# EAGLE schematic Resistor_Resistor (EAGLE 8.3.0), part 41 of 43
## Nets (continued)
N$173: R32601.2 R32602.2 R32603.2 R32604.2 R32605.2 R32606.2 R32607.2 R32608.2 R32609.2 R32610.2 R32611.2 R32612.2 R32613.2 R32614.2 R32615.2 R32616.2 R32617.2 R32618.2 R32619.2 R32620.2 R32621.2 R32622.2 R32623.2 R32624.2 R32625.2 R32626.2 R32627.2 R32628.2 R32629.2 R32630.2 R32631.2 R32632.2 R32633.2 R32634.2 R32635.2 R32636.2 R32637.2 R32638.2 R32639.2 R32640.2 R32641.2 R32642.2 R32643.2 R32644.2 R32645.2 R32646.2 R32647.2 R32648.2 R32649.2 R32650.2 R32651.2 R32652.2 R32653.2 R32654.2 R32655.2 R32656.2 R32657.2 R32658.2 R32659.2 R32660.2 R32661.2 R32662.2 R32663.2 R32664.2 R32665.2 R32666.2 R32667.2 R32668.2 R32669.2 R32670.2 R32671.2 R32672.2 R32673.2 R32674.2 R32675.2 R32676.2 R32677.2 R32678.2 R32679.2 R32680.2 R32681.2 R32682.2 R32683.2 R32684.2 R32685.2 R32686.2 R32687.2 R32688.2 R32689.2 R32690.2 R32691.2 R32692.2 R32693.2 R32694.2 R32695.2 R32696.2 R32697.2 R32698.2 R32699.2 R32700.2 R32701.2 R32702.2 R32703.2 R32704.2 R32705.2 R32706.2 R32707.2 R32708.2 R32709.2 R32710.2 R32711.2 R32712.2 R32713.2 R32714.2 R32715.2 R32716.2 R32717.2 R32718.2 R32719.2 R32720.2 R32721.2 R32722.2 R32723.2 R32724.2 R32725.2 R32726.2 R32727.2 R32728.2 R32729.2 R32730.2 R32731.2 R32732.2 R32733.2 R32734.2 R32735.2 R32736.2 R32737.2 R32738.2 R32739.2 R32740.2 R32741.2 R32742.2 R32743.2 R32744.2 R32745.2 R32746.2 R32747.2 R32748.2 R32749.2 R32750.2 R32751.2 R32752.2 R32753.2 R32754.2 R32755.2 R32756.2 R32757.2 R32758.2 R32759.2 R32760.2 R32761.2 R32762.2 R32763.2 R32764.2 R32765.2 R32766.2 R32767.2 R32768.2 R32769.2 R32770.2 R32771.2 R32772.2 R32773.2 R32774.2 R32775.2 R32776.2 R32777.2 R32778.2 R32779.2 R32780.2 R32781.2 R32782.2 R32783.2 R32784.2 R32785.2 R32786.2 R32787.2 R32788.2 R32789.2 R32790.2 R32791.2 R32792.2 R32793.2 R32794.2 R32795.2 R32796.2 R32797.2 R32798.2 R32799.2 R32800.2 R32801.1 R32802.1 R32803.1 R32804.1 R32805.1 R32806.1 R32807.1 R32808.1 R32809.1 R32810.1 R32811.1 R32812.1 R32813.1 R32814.1 R32815.1 R32816.1 R32817.1 R32818.1 R32819.1 R32820.1 R32821.1 R32822.1 R32823.1 R32824.1 R32825.1 R32826.1 R32827.1 R32828.1 R32829.1 R32830.1 R32831.1 R32832.1 R32833.1 R32834.1 R32835.1 R32836.1 R32837.1 R32838.1 R32839.1 R32840.1 R32841.1 R32842.1 R32843.1 R32844.1 R32845.1 R32846.1 R32847.1 R32848.1 R32849.1 R32850.1 R32851.1 R32852.1 R32853.1 R32854.1 R32855.1 R32856.1 R32857.1 R32858.1 R32859.1 R32860.1 R32861.1 R32862.1 R32863.1 R32864.1 R32865.1 R32866.1 R32867.1 R32868.1 R32869.1 R32870.1 R32871.1 R32872.1 R32873.1 R32874.1 R32875.1 R32876.1 R32877.1 R32878.1 R32879.1 R32880.1 R32881.1 R32882.1 R32883.1 R32884.1 R32885.1 R32886.1 R32887.1 R32888.1 R32889.1 R32890.1 R32891.1 R32892.1 R32893.1 R32894.1 R32895.1 R32896.1 R32897.1 R32898.1 R32899.1 R32900.1 R32901.1 R32902.1 R32903.1 R32904.1 R32905.1 R32906.1 R32907.1 R32908.1 R32909.1 R32910.1 R32911.1 R32912.1 R32913.1 R32914.1 R32915.1 R32916.1 R32917.1 R32918.1 R32919.1 R32920.1 R32921.1 R32922.1 R32923.1 R32924.1 R32925.1 R32926.1 R32927.1 R32928.1 R32929.1 R32930.1 R32931.1 R32932.1 R32933.1 R32934.1 R32935.1 R32936.1 R32937.1 R32938.1 R32939.1 R32940.1 R32941.1 R32942.1 R32943.1 R32944.1 R32945.1 R32946.1 R32947.1 R32948.1 R32949.1 R32950.1 R32951.1 R32952.1 R32953.1 R32954.1 R32955.1 R32956.1 R32957.1 R32958.1 R32959.1 R32960.1 R32961.1 R32962.1 R32963.1 R32964.1 R32965.1 R32966.1 R32967.1 R32968.1 R32969.1 R32970.1 R32971.1 R32972.1 R32973.1 R32974.1 R32975.1 R32976.1 R32977.1 R32978.1 R32979.1 R32980.1 R32981.1 R32982.1 R32983.1 R32984.1 R32985.1 R32986.1 R32987.1 R32988.1 R32989.1 R32990.1 R32991.1 R32992.1 R32993.1 R32994.1 R32995.1 R32996.1 R32997.1 R32998.1 R32999.1 R33000.1
N$174: R32801.2 R32802.2 R32803.2 R32804.2 R32805.2 R32806.2 R32807.2 R32808.2 R32809.2 R32810.2 R32811.2 R32812.2 R32813.2 R32814.2 R32815.2 R32816.2 R32817.2 R32818.2 R32819.2 R32820.2 R32821.2 R32822.2 R32823.2 R32824.2 R32825.2 R32826.2 R32827.2 R32828.2 R32829.2 R32830.2 R32831.2 R32832.2 R32833.2 R32834.2 R32835.2 R32836.2 R32837.2 R32838.2 R32839.2 R32840.2 R32841.2 R32842.2 R32843.2 R32844.2 R32845.2 R32846.2 R32847.2 R32848.2 R32849.2 R32850.2 R32851.2 R32852.2 R32853.2 R32854.2 R32855.2 R32856.2 R32857.2 R32858.2 R32859.2 R32860.2 R32861.2 R32862.2 R32863.2 R32864.2 R32865.2 R32866.2 R32867.2 R32868.2 R32869.2 R32870.2 R32871.2 R32872.2 R32873.2 R32874.2 R32875.2 R32876.2 R32877.2 R32878.2 R32879.2 R32880.2 R32881.2 R32882.2 R32883.2 R32884.2 R32885.2 R32886.2 R32887.2 R32888.2 R32889.2 R32890.2 R32891.2 R32892.2 R32893.2 R32894.2 R32895.2 R32896.2 R32897.2 R32898.2 R32899.2 R32900.2 R32901.2 R32902.2 R32903.2 R32904.2 R32905.2 R32906.2 R32907.2 R32908.2 R32909.2 R32910.2 R32911.2 R32912.2 R32913.2 R32914.2 R32915.2 R32916.2 R32917.2 R32918.2 R32919.2 R32920.2 R32921.2 R32922.2 R32923.2 R32924.2 R32925.2 R32926.2 R32927.2 R32928.2 R32929.2 R32930.2 R32931.2 R32932.2 R32933.2 R32934.2 R32935.2 R32936.2 R32937.2 R32938.2 R32939.2 R32940.2 R32941.2 R32942.2 R32943.2 R32944.2 R32945.2 R32946.2 R32947.2 R32948.2 R32949.2 R32950.2 R32951.2 R32952.2 R32953.2 R32954.2 R32955.2 R32956.2 R32957.2 R32958.2 R32959.2 R32960.2 R32961.2 R32962.2 R32963.2 R32964.2 R32965.2 R32966.2 R32967.2 R32968.2 R32969.2 R32970.2 R32971.2 R32972.2 R32973.2 R32974.2 R32975.2 R32976.2 R32977.2 R32978.2 R32979.2 R32980.2 R32981.2 R32982.2 R32983.2 R32984.2 R32985.2 R32986.2 R32987.2 R32988.2 R32989.2 R32990.2 R32991.2 R32992.2 R32993.2 R32994.2 R32995.2 R32996.2 R32997.2 R32998.2 R32999.2 R33000.2 R33001.1 R33002.1 R33003.1 R33004.1 R33005.1 R33006.1 R33007.1 R33008.1 R33009.1 R33010.1 R33011.1 R33012.1 R33013.1 R33014.1 R33015.1 R33016.1 R33017.1 R33018.1 R33019.1 R33020.1 R33021.1 R33022.1 R33023.1 R33024.1 R33025.1 R33026.1 R33027.1 R33028.1 R33029.1 R33030.1 R33031.1 R33032.1 R33033.1 R33034.1 R33035.1 R33036.1 R33037.1 R33038.1 R33039.1 R33040.1 R33041.1 R33042.1 R33043.1 R33044.1 R33045.1 R33046.1 R33047.1 R33048.1 R33049.1 R33050.1 R33051.1 R33052.1 R33053.1 R33054.1 R33055.1 R33056.1 R33057.1 R33058.1 R33059.1 R33060.1 R33061.1 R33062.1 R33063.1 R33064.1 R33065.1 R33066.1 R33067.1 R33068.1 R33069.1 R33070.1 R33071.1 R33072.1 R33073.1 R33074.1 R33075.1 R33076.1 R33077.1 R33078.1 R33079.1 R33080.1 R33081.1 R33082.1 R33083.1 R33084.1 R33085.1 R33086.1 R33087.1 R33088.1 R33089.1 R33090.1 R33091.1 R33092.1 R33093.1 R33094.1 R33095.1 R33096.1 R33097.1 R33098.1 R33099.1 R33100.1 R33101.1 R33102.1 R33103.1 R33104.1 R33105.1 R33106.1 R33107.1 R33108.1 R33109.1 R33110.1 R33111.1 R33112.1 R33113.1 R33114.1 R33115.1 R33116.1 R33117.1 R33118.1 R33119.1 R33120.1 R33121.1 R33122.1 R33123.1 R33124.1 R33125.1 R33126.1 R33127.1 R33128.1 R33129.1 R33130.1 R33131.1 R33132.1 R33133.1 R33134.1 R33135.1 R33136.1 R33137.1 R33138.1 R33139.1 R33140.1 R33141.1 R33142.1 R33143.1 R33144.1 R33145.1 R33146.1 R33147.1 R33148.1 R33149.1 R33150.1 R33151.1 R33152.1 R33153.1 R33154.1 R33155.1 R33156.1 R33157.1 R33158.1 R33159.1 R33160.1 R33161.1 R33162.1 R33163.1 R33164.1 R33165.1 R33166.1 R33167.1 R33168.1 R33169.1 R33170.1 R33171.1 R33172.1 R33173.1 R33174.1 R33175.1 R33176.1 R33177.1 R33178.1 R33179.1 R33180.1 R33181.1 R33182.1 R33183.1 R33184.1 R33185.1 R33186.1 R33187.1 R33188.1 R33189.1 R33190.1 R33191.1 R33192.1 R33193.1 R33194.1 R33195.1 R33196.1 R33197.1 R33198.1 R33199.1 R33200.1
N$175: R33001.2 R33002.2 R33003.2 R33004.2 R33005.2 R33006.2 R33007.2 R33008.2 R33009.2 R33010.2 R33011.2 R33012.2 R33013.2 R33014.2 R33015.2 R33016.2 R33017.2 R33018.2 R33019.2 R33020.2 R33021.2 R33022.2 R33023.2 R33024.2 R33025.2 R33026.2 R33027.2 R33028.2 R33029.2 R33030.2 R33031.2 R33032.2 R33033.2 R33034.2 R33035.2 R33036.2 R33037.2 R33038.2 R33039.2 R33040.2 R33041.2 R33042.2 R33043.2 R33044.2 R33045.2 R33046.2 R33047.2 R33048.2 R33049.2 R33050.2 R33051.2 R33052.2 R33053.2 R33054.2 R33055.2 R33056.2 R33057.2 R33058.2 R33059.2 R33060.2 R33061.2 R33062.2 R33063.2 R33064.2 R33065.2 R33066.2 R33067.2 R33068.2 R33069.2 R33070.2 R33071.2 R33072.2 R33073.2 R33074.2 R33075.2 R33076.2 R33077.2 R33078.2 R33079.2 R33080.2 R33081.2 R33082.2 R33083.2 R33084.2 R33085.2 R33086.2 R33087.2 R33088.2 R33089.2 R33090.2 R33091.2 R33092.2 R33093.2 R33094.2 R33095.2 R33096.2 R33097.2 R33098.2 R33099.2 R33100.2 R33101.2 R33102.2 R33103.2 R33104.2 R33105.2 R33106.2 R33107.2 R33108.2 R33109.2 R33110.2 R33111.2 R33112.2 R33113.2 R33114.2 R33115.2 R33116.2 R33117.2 R33118.2 R33119.2 R33120.2 R33121.2 R33122.2 R33123.2 R33124.2 R33125.2 R33126.2 R33127.2 R33128.2 R33129.2 R33130.2 R33131.2 R33132.2 R33133.2 R33134.2 R33135.2 R33136.2 R33137.2 R33138.2 R33139.2 R33140.2 R33141.2 R33142.2 R33143.2 R33144.2 R33145.2 R33146.2 R33147.2 R33148.2 R33149.2 R33150.2 R33151.2 R33152.2 R33153.2 R33154.2 R33155.2 R33156.2 R33157.2 R33158.2 R33159.2 R33160.2 R33161.2 R33162.2 R33163.2 R33164.2 R33165.2 R33166.2 R33167.2 R33168.2 R33169.2 R33170.2 R33171.2 R33172.2 R33173.2 R33174.2 R33175.2 R33176.2 R33177.2 R33178.2 R33179.2 R33180.2 R33181.2 R33182.2 R33183.2 R33184.2 R33185.2 R33186.2 R33187.2 R33188.2 R33189.2 R33190.2 R33191.2 R33192.2 R33193.2 R33194.2 R33195.2 R33196.2 R33197.2 R33198.2 R33199.2 R33200.2 R33201.1 R33202.1 R33203.1 R33204.1 R33205.1 R33206.1 R33207.1 R33208.1 R33209.1 R33210.1 R33211.1 R33212.1 R33213.1 R33214.1 R33215.1 R33216.1 R33217.1 R33218.1 R33219.1 R33220.1 R33221.1 R33222.1 R33223.1 R33224.1 R33225.1 R33226.1 R33227.1 R33228.1 R33229.1 R33230.1 R33231.1 R33232.1 R33233.1 R33234.1 R33235.1 R33236.1 R33237.1 R33238.1 R33239.1 R33240.1 R33241.1 R33242.1 R33243.1 R33244.1 R33245.1 R33246.1 R33247.1 R33248.1 R33249.1 R33250.1 R33251.1 R33252.1 R33253.1 R33254.1 R33255.1 R33256.1 R33257.1 R33258.1 R33259.1 R33260.1 R33261.1 R33262.1 R33263.1 R33264.1 R33265.1 R33266.1 R33267.1 R33268.1 R33269.1 R33270.1 R33271.1 R33272.1 R33273.1 R33274.1 R33275.1 R33276.1 R33277.1 R33278.1 R33279.1 R33280.1 R33281.1 R33282.1 R33283.1 R33284.1 R33285.1 R33286.1 R33287.1 R33288.1 R33289.1 R33290.1 R33291.1 R33292.1 R33293.1 R33294.1 R33295.1 R33296.1 R33297.1 R33298.1 R33299.1 R33300.1 R33301.1 R33302.1 R33303.1 R33304.1 R33305.1 R33306.1 R33307.1 R33308.1 R33309.1 R33310.1 R33311.1 R33312.1 R33313.1 R33314.1 R33315.1 R33316.1 R33317.1 R33318.1 R33319.1 R33320.1 R33321.1 R33322.1 R33323.1 R33324.1 R33325.1 R33326.1 R33327.1 R33328.1 R33329.1 R33330.1 R33331.1 R33332.1 R33333.1 R33334.1 R33335.1 R33336.1 R33337.1 R33338.1 R33339.1 R33340.1 R33341.1 R33342.1 R33343.1 R33344.1 R33345.1 R33346.1 R33347.1 R33348.1 R33349.1 R33350.1 R33351.1 R33352.1 R33353.1 R33354.1 R33355.1 R33356.1 R33357.1 R33358.1 R33359.1 R33360.1 R33361.1 R33362.1 R33363.1 R33364.1 R33365.1 R33366.1 R33367.1 R33368.1 R33369.1 R33370.1 R33371.1 R33372.1 R33373.1 R33374.1 R33375.1 R33376.1 R33377.1 R33378.1 R33379.1 R33380.1 R33381.1 R33382.1 R33383.1 R33384.1 R33385.1 R33386.1 R33387.1 R33388.1 R33389.1 R33390.1 R33391.1 R33392.1 R33393.1 R33394.1 R33395.1 R33396.1 R33397.1 R33398.1 R33399.1 R33400.1
N$176: R33201.2 R33202.2 R33203.2 R33204.2 R33205.2 R33206.2 R33207.2 R33208.2 R33209.2 R33210.2 R33211.2 R33212.2 R33213.2 R33214.2 R33215.2 R33216.2 R33217.2 R33218.2 R33219.2 R33220.2 R33221.2 R33222.2 R33223.2 R33224.2 R33225.2 R33226.2 R33227.2 R33228.2 R33229.2 R33230.2 R33231.2 R33232.2 R33233.2 R33234.2 R33235.2 R33236.2 R33237.2 R33238.2 R33239.2 R33240.2 R33241.2 R33242.2 R33243.2 R33244.2 R33245.2 R33246.2 R33247.2 R33248.2 R33249.2 R33250.2 R33251.2 R33252.2 R33253.2 R33254.2 R33255.2 R33256.2 R33257.2 R33258.2 R33259.2 R33260.2 R33261.2 R33262.2 R33263.2 R33264.2 R33265.2 R33266.2 R33267.2 R33268.2 R33269.2 R33270.2 R33271.2 R33272.2 R33273.2 R33274.2 R33275.2 R33276.2 R33277.2 R33278.2 R33279.2 R33280.2 R33281.2 R33282.2 R33283.2 R33284.2 R33285.2 R33286.2 R33287.2 R33288.2 R33289.2 R33290.2 R33291.2 R33292.2 R33293.2 R33294.2 R33295.2 R33296.2 R33297.2 R33298.2 R33299.2 R33300.2 R33301.2 R33302.2 R33303.2 R33304.2 R33305.2 R33306.2 R33307.2 R33308.2 R33309.2 R33310.2 R33311.2 R33312.2 R33313.2 R33314.2 R33315.2 R33316.2 R33317.2 R33318.2 R33319.2 R33320.2 R33321.2 R33322.2 R33323.2 R33324.2 R33325.2 R33326.2 R33327.2 R33328.2 R33329.2 R33330.2 R33331.2 R33332.2 R33333.2 R33334.2 R33335.2 R33336.2 R33337.2 R33338.2 R33339.2 R33340.2 R33341.2 R33342.2 R33343.2 R33344.2 R33345.2 R33346.2 R33347.2 R33348.2 R33349.2 R33350.2 R33351.2 R33352.2 R33353.2 R33354.2 R33355.2 R33356.2 R33357.2 R33358.2 R33359.2 R33360.2 R33361.2 R33362.2 R33363.2 R33364.2 R33365.2 R33366.2 R33367.2 R33368.2 R33369.2 R33370.2 R33371.2 R33372.2 R33373.2 R33374.2 R33375.2 R33376.2 R33377.2 R33378.2 R33379.2 R33380.2 R33381.2 R33382.2 R33383.2 R33384.2 R33385.2 R33386.2 R33387.2 R33388.2 R33389.2 R33390.2 R33391.2 R33392.2 R33393.2 R33394.2 R33395.2 R33396.2 R33397.2 R33398.2 R33399.2 R33400.2 R33401.1 R33402.1 R33403.1 R33404.1 R33405.1 R33406.1 R33407.1 R33408.1 R33409.1 R33410.1 R33411.1 R33412.1 R33413.1 R33414.1 R33415.1 R33416.1 R33417.1 R33418.1 R33419.1 R33420.1 R33421.1 R33422.1 R33423.1 R33424.1 R33425.1 R33426.1 R33427.1 R33428.1 R33429.1 R33430.1 R33431.1 R33432.1 R33433.1 R33434.1 R33435.1 R33436.1 R33437.1 R33438.1 R33439.1 R33440.1 R33441.1 R33442.1 R33443.1 R33444.1 R33445.1 R33446.1 R33447.1 R33448.1 R33449.1 R33450.1 R33451.1 R33452.1 R33453.1 R33454.1 R33455.1 R33456.1 R33457.1 R33458.1 R33459.1 R33460.1 R33461.1 R33462.1 R33463.1 R33464.1 R33465.1 R33466.1 R33467.1 R33468.1 R33469.1 R33470.1 R33471.1 R33472.1 R33473.1 R33474.1 R33475.1 R33476.1 R33477.1 R33478.1 R33479.1 R33480.1 R33481.1 R33482.1 R33483.1 R33484.1 R33485.1 R33486.1 R33487.1 R33488.1 R33489.1 R33490.1 R33491.1 R33492.1 R33493.1 R33494.1 R33495.1 R33496.1 R33497.1 R33498.1 R33499.1 R33500.1 R33501.1 R33502.1 R33503.1 R33504.1 R33505.1 R33506.1 R33507.1 R33508.1 R33509.1 R33510.1 R33511.1 R33512.1 R33513.1 R33514.1 R33515.1 R33516.1 R33517.1 R33518.1 R33519.1 R33520.1 R33521.1 R33522.1 R33523.1 R33524.1 R33525.1 R33526.1 R33527.1 R33528.1 R33529.1 R33530.1 R33531.1 R33532.1 R33533.1 R33534.1 R33535.1 R33536.1 R33537.1 R33538.1 R33539.1 R33540.1 R33541.1 R33542.1 R33543.1 R33544.1 R33545.1 R33546.1 R33547.1 R33548.1 R33549.1 R33550.1 R33551.1 R33552.1 R33553.1 R33554.1 R33555.1 R33556.1 R33557.1 R33558.1 R33559.1 R33560.1 R33561.1 R33562.1 R33563.1 R33564.1 R33565.1 R33566.1 R33567.1 R33568.1 R33569.1 R33570.1 R33571.1 R33572.1 R33573.1 R33574.1 R33575.1 R33576.1 R33577.1 R33578.1 R33579.1 R33580.1 R33581.1 R33582.1 R33583.1 R33584.1 R33585.1 R33586.1 R33587.1 R33588.1 R33589.1 R33590.1 R33591.1 R33592.1 R33593.1 R33594.1 R33595.1 R33596.1 R33597.1 R33598.1 R33599.1 R33600.1
N$177: R33401.2 R33402.2 R33403.2 R33404.2 R33405.2 R33406.2 R33407.2 R33408.2 R33409.2 R33410.2 R33411.2 R33412.2 R33413.2 R33414.2 R33415.2 R33416.2 R33417.2 R33418.2 R33419.2 R33420.2 R33421.2 R33422.2 R33423.2 R33424.2 R33425.2 R33426.2 R33427.2 R33428.2 R33429.2 R33430.2 R33431.2 R33432.2 R33433.2 R33434.2 R33435.2 R33436.2 R33437.2 R33438.2 R33439.2 R33440.2 R33441.2 R33442.2 R33443.2 R33444.2 R33445.2 R33446.2 R33447.2 R33448.2 R33449.2 R33450.2 R33451.2 R33452.2 R33453.2 R33454.2 R33455.2 R33456.2 R33457.2 R33458.2 R33459.2 R33460.2 R33461.2 R33462.2 R33463.2 R33464.2 R33465.2 R33466.2 R33467.2 R33468.2 R33469.2 R33470.2 R33471.2 R33472.2 R33473.2 R33474.2 R33475.2 R33476.2 R33477.2 R33478.2 R33479.2 R33480.2 R33481.2 R33482.2 R33483.2 R33484.2 R33485.2 R33486.2 R33487.2 R33488.2 R33489.2 R33490.2 R33491.2 R33492.2 R33493.2 R33494.2 R33495.2 R33496.2 R33497.2 R33498.2 R33499.2 R33500.2 R33501.2 R33502.2 R33503.2 R33504.2 R33505.2 R33506.2 R33507.2 R33508.2 R33509.2 R33510.2 R33511.2 R33512.2 R33513.2 R33514.2 R33515.2 R33516.2 R33517.2 R33518.2 R33519.2 R33520.2 R33521.2 R33522.2 R33523.2 R33524.2 R33525.2 R33526.2 R33527.2 R33528.2 R33529.2 R33530.2 R33531.2 R33532.2 R33533.2 R33534.2 R33535.2 R33536.2 R33537.2 R33538.2 R33539.2 R33540.2 R33541.2 R33542.2 R33543.2 R33544.2 R33545.2 R33546.2 R33547.2 R33548.2 R33549.2 R33550.2 R33551.2 R33552.2 R33553.2 R33554.2 R33555.2 R33556.2 R33557.2 R33558.2 R33559.2 R33560.2 R33561.2 R33562.2 R33563.2 R33564.2 R33565.2 R33566.2 R33567.2 R33568.2 R33569.2 R33570.2 R33571.2 R33572.2 R33573.2 R33574.2 R33575.2 R33576.2 R33577.2 R33578.2 R33579.2 R33580.2 R33581.2 R33582.2 R33583.2 R33584.2 R33585.2 R33586.2 R33587.2 R33588.2 R33589.2 R33590.2 R33591.2 R33592.2 R33593.2 R33594.2 R33595.2 R33596.2 R33597.2 R33598.2 R33599.2 R33600.2 R33601.1 R33602.1 R33603.1 R33604.1 R33605.1 R33606.1 R33607.1 R33608.1 R33609.1 R33610.1 R33611.1 R33612.1 R33613.1 R33614.1 R33615.1 R33616.1 R33617.1 R33618.1 R33619.1 R33620.1 R33621.1 R33622.1 R33623.1 R33624.1 R33625.1 R33626.1 R33627.1 R33628.1 R33629.1 R33630.1 R33631.1 R33632.1 R33633.1 R33634.1 R33635.1 R33636.1 R33637.1 R33638.1 R33639.1 R33640.1 R33641.1 R33642.1 R33643.1 R33644.1 R33645.1 R33646.1 R33647.1 R33648.1 R33649.1 R33650.1 R33651.1 R33652.1 R33653.1 R33654.1 R33655.1 R33656.1 R33657.1 R33658.1 R33659.1 R33660.1 R33661.1 R33662.1 R33663.1 R33664.1 R33665.1 R33666.1 R33667.1 R33668.1 R33669.1 R33670.1 R33671.1 R33672.1 R33673.1 R33674.1 R33675.1 R33676.1 R33677.1 R33678.1 R33679.1 R33680.1 R33681.1 R33682.1 R33683.1 R33684.1 R33685.1 R33686.1 R33687.1 R33688.1 R33689.1 R33690.1 R33691.1 R33692.1 R33693.1 R33694.1 R33695.1 R33696.1 R33697.1 R33698.1 R33699.1 R33700.1 R33701.1 R33702.1 R33703.1 R33704.1 R33705.1 R33706.1 R33707.1 R33708.1 R33709.1 R33710.1 R33711.1 R33712.1 R33713.1 R33714.1 R33715.1 R33716.1 R33717.1 R33718.1 R33719.1 R33720.1 R33721.1 R33722.1 R33723.1 R33724.1 R33725.1 R33726.1 R33727.1 R33728.1 R33729.1 R33730.1 R33731.1 R33732.1 R33733.1 R33734.1 R33735.1 R33736.1 R33737.1 R33738.1 R33739.1 R33740.1 R33741.1 R33742.1 R33743.1 R33744.1 R33745.1 R33746.1 R33747.1 R33748.1 R33749.1 R33750.1 R33751.1 R33752.1 R33753.1 R33754.1 R33755.1 R33756.1 R33757.1 R33758.1 R33759.1 R33760.1 R33761.1 R33762.1 R33763.1 R33764.1 R33765.1 R33766.1 R33767.1 R33768.1 R33769.1 R33770.1 R33771.1 R33772.1 R33773.1 R33774.1 R33775.1 R33776.1 R33777.1 R33778.1 R33779.1 R33780.1 R33781.1 R33782.1 R33783.1 R33784.1 R33785.1 R33786.1 R33787.1 R33788.1 R33789.1 R33790.1 R33791.1 R33792.1 R33793.1 R33794.1 R33795.1 R33796.1 R33797.1 R33798.1 R33799.1 R33800.1
N$178: R33601.2 R33602.2 R33603.2 R33604.2 R33605.2 R33606.2 R33607.2 R33608.2 R33609.2 R33610.2 R33611.2 R33612.2 R33613.2 R33614.2 R33615.2 R33616.2 R33617.2 R33618.2 R33619.2 R33620.2 R33621.2 R33622.2 R33623.2 R33624.2 R33625.2 R33626.2 R33627.2 R33628.2 R33629.2 R33630.2 R33631.2 R33632.2 R33633.2 R33634.2 R33635.2 R33636.2 R33637.2 R33638.2 R33639.2 R33640.2 R33641.2 R33642.2 R33643.2 R33644.2 R33645.2 R33646.2 R33647.2 R33648.2 R33649.2 R33650.2 R33651.2 R33652.2 R33653.2 R33654.2 R33655.2 R33656.2 R33657.2 R33658.2 R33659.2 R33660.2 R33661.2 R33662.2 R33663.2 R33664.2 R33665.2 R33666.2 R33667.2 R33668.2 R33669.2 R33670.2 R33671.2 R33672.2 R33673.2 R33674.2 R33675.2 R33676.2 R33677.2 R33678.2 R33679.2 R33680.2 R33681.2 R33682.2 R33683.2 R33684.2 R33685.2 R33686.2 R33687.2 R33688.2 R33689.2 R33690.2 R33691.2 R33692.2 R33693.2 R33694.2 R33695.2 R33696.2 R33697.2 R33698.2 R33699.2 R33700.2 R33701.2 R33702.2 R33703.2 R33704.2 R33705.2 R33706.2 R33707.2 R33708.2 R33709.2 R33710.2 R33711.2 R33712.2 R33713.2 R33714.2 R33715.2 R33716.2 R33717.2 R33718.2 R33719.2 R33720.2 R33721.2 R33722.2 R33723.2 R33724.2 R33725.2 R33726.2 R33727.2 R33728.2 R33729.2 R33730.2 R33731.2 R33732.2 R33733.2 R33734.2 R33735.2 R33736.2 R33737.2 R33738.2 R33739.2 R33740.2 R33741.2 R33742.2 R33743.2 R33744.2 R33745.2 R33746.2 R33747.2 R33748.2 R33749.2 R33750.2 R33751.2 R33752.2 R33753.2 R33754.2 R33755.2 R33756.2 R33757.2 R33758.2 R33759.2 R33760.2 R33761.2 R33762.2 R33763.2 R33764.2 R33765.2 R33766.2 R33767.2 R33768.2 R33769.2 R33770.2 R33771.2 R33772.2 R33773.2 R33774.2 R33775.2 R33776.2 R33777.2 R33778.2 R33779.2 R33780.2 R33781.2 R33782.2 R33783.2 R33784.2 R33785.2 R33786.2 R33787.2 R33788.2 R33789.2 R33790.2 R33791.2 R33792.2 R33793.2 R33794.2 R33795.2 R33796.2 R33797.2 R33798.2 R33799.2 R33800.2 R33801.1 R33802.1 R33803.1 R33804.1 R33805.1 R33806.1 R33807.1 R33808.1 R33809.1 R33810.1 R33811.1 R33812.1 R33813.1 R33814.1 R33815.1 R33816.1 R33817.1 R33818.1 R33819.1 R33820.1 R33821.1 R33822.1 R33823.1 R33824.1 R33825.1 R33826.1 R33827.1 R33828.1 R33829.1 R33830.1 R33831.1 R33832.1 R33833.1 R33834.1 R33835.1 R33836.1 R33837.1 R33838.1 R33839.1 R33840.1 R33841.1 R33842.1 R33843.1 R33844.1 R33845.1 R33846.1 R33847.1 R33848.1 R33849.1 R33850.1 R33851.1 R33852.1 R33853.1 R33854.1 R33855.1 R33856.1 R33857.1 R33858.1 R33859.1 R33860.1 R33861.1 R33862.1 R33863.1 R33864.1 R33865.1 R33866.1 R33867.1 R33868.1 R33869.1 R33870.1 R33871.1 R33872.1 R33873.1 R33874.1 R33875.1 R33876.1 R33877.1 R33878.1 R33879.1 R33880.1 R33881.1 R33882.1 R33883.1 R33884.1 R33885.1 R33886.1 R33887.1 R33888.1 R33889.1 R33890.1 R33891.1 R33892.1 R33893.1 R33894.1 R33895.1 R33896.1 R33897.1 R33898.1 R33899.1 R33900.1 R33901.1 R33902.1 R33903.1 R33904.1 R33905.1 R33906.1 R33907.1 R33908.1 R33909.1 R33910.1 R33911.1 R33912.1 R33913.1 R33914.1 R33915.1 R33916.1 R33917.1 R33918.1 R33919.1 R33920.1 R33921.1 R33922.1 R33923.1 R33924.1 R33925.1 R33926.1 R33927.1 R33928.1 R33929.1 R33930.1 R33931.1 R33932.1 R33933.1 R33934.1 R33935.1 R33936.1 R33937.1 R33938.1 R33939.1 R33940.1 R33941.1 R33942.1 R33943.1 R33944.1 R33945.1 R33946.1 R33947.1 R33948.1 R33949.1 R33950.1 R33951.1 R33952.1 R33953.1 R33954.1 R33955.1 R33956.1 R33957.1 R33958.1 R33959.1 R33960.1 R33961.1 R33962.1 R33963.1 R33964.1 R33965.1 R33966.1 R33967.1 R33968.1 R33969.1 R33970.1 R33971.1 R33972.1 R33973.1 R33974.1 R33975.1 R33976.1 R33977.1 R33978.1 R33979.1 R33980.1 R33981.1 R33982.1 R33983.1 R33984.1 R33985.1 R33986.1 R33987.1 R33988.1 R33989.1 R33990.1 R33991.1 R33992.1 R33993.1 R33994.1 R33995.1 R33996.1 R33997.1 R33998.1 R33999.1 R34000.1
N$179: R33801.2 R33802.2 R33803.2 R33804.2 R33805.2 R33806.2 R33807.2 R33808.2 R33809.2 R33810.2 R33811.2 R33812.2 R33813.2 R33814.2 R33815.2 R33816.2 R33817.2 R33818.2 R33819.2 R33820.2 R33821.2 R33822.2 R33823.2 R33824.2 R33825.2 R33826.2 R33827.2 R33828.2 R33829.2 R33830.2 R33831.2 R33832.2 R33833.2 R33834.2 R33835.2 R33836.2 R33837.2 R33838.2 R33839.2 R33840.2 R33841.2 R33842.2 R33843.2 R33844.2 R33845.2 R33846.2 R33847.2 R33848.2 R33849.2 R33850.2 R33851.2 R33852.2 R33853.2 R33854.2 R33855.2 R33856.2 R33857.2 R33858.2 R33859.2 R33860.2 R33861.2 R33862.2 R33863.2 R33864.2 R33865.2 R33866.2 R33867.2 R33868.2 R33869.2 R33870.2 R33871.2 R33872.2 R33873.2 R33874.2 R33875.2 R33876.2 R33877.2 R33878.2 R33879.2 R33880.2 R33881.2 R33882.2 R33883.2 R33884.2 R33885.2 R33886.2 R33887.2 R33888.2 R33889.2 R33890.2 R33891.2 R33892.2 R33893.2 R33894.2 R33895.2 R33896.2 R33897.2 R33898.2 R33899.2 R33900.2 R33901.2 R33902.2 R33903.2 R33904.2 R33905.2 R33906.2 R33907.2 R33908.2 R33909.2 R33910.2 R33911.2 R33912.2 R33913.2 R33914.2 R33915.2 R33916.2 R33917.2 R33918.2 R33919.2 R33920.2 R33921.2 R33922.2 R33923.2 R33924.2 R33925.2 R33926.2 R33927.2 R33928.2 R33929.2 R33930.2 R33931.2 R33932.2 R33933.2 R33934.2 R33935.2 R33936.2 R33937.2 R33938.2 R33939.2 R33940.2 R33941.2 R33942.2 R33943.2 R33944.2 R33945.2 R33946.2 R33947.2 R33948.2 R33949.2 R33950.2 R33951.2 R33952.2 R33953.2 R33954.2 R33955.2 R33956.2 R33957.2 R33958.2 R33959.2 R33960.2 R33961.2 R33962.2 R33963.2 R33964.2 R33965.2 R33966.2 R33967.2 R33968.2 R33969.2 R33970.2 R33971.2 R33972.2 R33973.2 R33974.2 R33975.2 R33976.2 R33977.2 R33978.2 R33979.2 R33980.2 R33981.2 R33982.2 R33983.2 R33984.2 R33985.2 R33986.2 R33987.2 R33988.2 R33989.2 R33990.2 R33991.2 R33992.2 R33993.2 R33994.2 R33995.2 R33996.2 R33997.2 R33998.2 R33999.2 R34000.2 R34001.1 R34002.1 R34003.1 R34004.1 R34005.1 R34006.1 R34007.1 R34008.1 R34009.1 R34010.1 R34011.1 R34012.1 R34013.1 R34014.1 R34015.1 R34016.1 R34017.1 R34018.1 R34019.1 R34020.1 R34021.1 R34022.1 R34023.1 R34024.1 R34025.1 R34026.1 R34027.1 R34028.1 R34029.1 R34030.1 R34031.1 R34032.1 R34033.1 R34034.1 R34035.1 R34036.1 R34037.1 R34038.1 R34039.1 R34040.1 R34041.1 R34042.1 R34043.1 R34044.1 R34045.1 R34046.1 R34047.1 R34048.1 R34049.1 R34050.1 R34051.1 R34052.1 R34053.1 R34054.1 R34055.1 R34056.1 R34057.1 R34058.1 R34059.1 R34060.1 R34061.1 R34062.1 R34063.1 R34064.1 R34065.1 R34066.1 R34067.1 R34068.1 R34069.1 R34070.1 R34071.1 R34072.1 R34073.1 R34074.1 R34075.1 R34076.1 R34077.1 R34078.1 R34079.1 R34080.1 R34081.1 R34082.1 R34083.1 R34084.1 R34085.1 R34086.1 R34087.1 R34088.1 R34089.1 R34090.1 R34091.1 R34092.1 R34093.1 R34094.1 R34095.1 R34096.1 R34097.1 R34098.1 R34099.1 R34100.1 R34101.1 R34102.1 R34103.1 R34104.1 R34105.1 R34106.1 R34107.1 R34108.1 R34109.1 R34110.1 R34111.1 R34112.1 R34113.1 R34114.1 R34115.1 R34116.1 R34117.1 R34118.1 R34119.1 R34120.1 R34121.1 R34122.1 R34123.1 R34124.1 R34125.1 R34126.1 R34127.1 R34128.1 R34129.1 R34130.1 R34131.1 R34132.1 R34133.1 R34134.1 R34135.1 R34136.1 R34137.1 R34138.1 R34139.1 R34140.1 R34141.1 R34142.1 R34143.1 R34144.1 R34145.1 R34146.1 R34147.1 R34148.1 R34149.1 R34150.1 R34151.1 R34152.1 R34153.1 R34154.1 R34155.1 R34156.1 R34157.1 R34158.1 R34159.1 R34160.1 R34161.1 R34162.1 R34163.1 R34164.1 R34165.1 R34166.1 R34167.1 R34168.1 R34169.1 R34170.1 R34171.1 R34172.1 R34173.1 R34174.1 R34175.1 R34176.1 R34177.1 R34178.1 R34179.1 R34180.1 R34181.1 R34182.1 R34183.1 R34184.1 R34185.1 R34186.1 R34187.1 R34188.1 R34189.1 R34190.1 R34191.1 R34192.1 R34193.1 R34194.1 R34195.1 R34196.1 R34197.1 R34198.1 R34199.1 R34200.1
N$180: R34001.2 R34002.2 R34003.2 R34004.2 R34005.2 R34006.2 R34007.2 R34008.2 R34009.2 R34010.2 R34011.2 R34012.2 R34013.2 R34014.2 R34015.2 R34016.2 R34017.2 R34018.2 R34019.2 R34020.2 R34021.2 R34022.2 R34023.2 R34024.2 R34025.2 R34026.2 R34027.2 R34028.2 R34029.2 R34030.2 R34031.2 R34032.2 R34033.2 R34034.2 R34035.2 R34036.2 R34037.2 R34038.2 R34039.2 R34040.2 R34041.2 R34042.2 R34043.2 R34044.2 R34045.2 R34046.2 R34047.2 R34048.2 R34049.2 R34050.2 R34051.2 R34052.2 R34053.2 R34054.2 R34055.2 R34056.2 R34057.2 R34058.2 R34059.2 R34060.2 R34061.2 R34062.2 R34063.2 R34064.2 R34065.2 R34066.2 R34067.2 R34068.2 R34069.2 R34070.2 R34071.2 R34072.2 R34073.2 R34074.2 R34075.2 R34076.2 R34077.2 R34078.2 R34079.2 R34080.2 R34081.2 R34082.2 R34083.2 R34084.2 R34085.2 R34086.2 R34087.2 R34088.2 R34089.2 R34090.2 R34091.2 R34092.2 R34093.2 R34094.2 R34095.2 R34096.2 R34097.2 R34098.2 R34099.2 R34100.2 R34101.2 R34102.2 R34103.2 R34104.2 R34105.2 R34106.2 R34107.2 R34108.2 R34109.2 R34110.2 R34111.2 R34112.2 R34113.2 R34114.2 R34115.2 R34116.2 R34117.2 R34118.2 R34119.2 R34120.2 R34121.2 R34122.2 R34123.2 R34124.2 R34125.2 R34126.2 R34127.2 R34128.2 R34129.2 R34130.2 R34131.2 R34132.2 R34133.2 R34134.2 R34135.2 R34136.2 R34137.2 R34138.2 R34139.2 R34140.2 R34141.2 R34142.2 R34143.2 R34144.2 R34145.2 R34146.2 R34147.2 R34148.2 R34149.2 R34150.2 R34151.2 R34152.2 R34153.2 R34154.2 R34155.2 R34156.2 R34157.2 R34158.2 R34159.2 R34160.2 R34161.2 R34162.2 R34163.2 R34164.2 R34165.2 R34166.2 R34167.2 R34168.2 R34169.2 R34170.2 R34171.2 R34172.2 R34173.2 R34174.2 R34175.2 R34176.2 R34177.2 R34178.2 R34179.2 R34180.2 R34181.2 R34182.2 R34183.2 R34184.2 R34185.2 R34186.2 R34187.2 R34188.2 R34189.2 R34190.2 R34191.2 R34192.2 R34193.2 R34194.2 R34195.2 R34196.2 R34197.2 R34198.2 R34199.2 R34200.2 R34201.1 R34202.1 R34203.1 R34204.1 R34205.1 R34206.1 R34207.1 R34208.1 R34209.1 R34210.1 R34211.1 R34212.1 R34213.1 R34214.1 R34215.1 R34216.1 R34217.1 R34218.1 R34219.1 R34220.1 R34221.1 R34222.1 R34223.1 R34224.1 R34225.1 R34226.1 R34227.1 R34228.1 R34229.1 R34230.1 R34231.1 R34232.1 R34233.1 R34234.1 R34235.1 R34236.1 R34237.1 R34238.1 R34239.1 R34240.1 R34241.1 R34242.1 R34243.1 R34244.1 R34245.1 R34246.1 R34247.1 R34248.1 R34249.1 R34250.1 R34251.1 R34252.1 R34253.1 R34254.1 R34255.1 R34256.1 R34257.1 R34258.1 R34259.1 R34260.1 R34261.1 R34262.1 R34263.1 R34264.1 R34265.1 R34266.1 R34267.1 R34268.1 R34269.1 R34270.1 R34271.1 R34272.1 R34273.1 R34274.1 R34275.1 R34276.1 R34277.1 R34278.1 R34279.1 R34280.1 R34281.1 R34282.1 R34283.1 R34284.1 R34285.1 R34286.1 R34287.1 R34288.1 R34289.1 R34290.1 R34291.1 R34292.1 R34293.1 R34294.1 R34295.1 R34296.1 R34297.1 R34298.1 R34299.1 R34300.1 R34301.1 R34302.1 R34303.1 R34304.1 R34305.1 R34306.1 R34307.1 R34308.1 R34309.1 R34310.1 R34311.1 R34312.1 R34313.1 R34314.1 R34315.1 R34316.1 R34317.1 R34318.1 R34319.1 R34320.1 R34321.1 R34322.1 R34323.1 R34324.1 R34325.1 R34326.1 R34327.1 R34328.1 R34329.1 R34330.1 R34331.1 R34332.1 R34333.1 R34334.1 R34335.1 R34336.1 R34337.1 R34338.1 R34339.1 R34340.1 R34341.1 R34342.1 R34343.1 R34344.1 R34345.1 R34346.1 R34347.1 R34348.1 R34349.1 R34350.1 R34351.1 R34352.1 R34353.1 R34354.1 R34355.1 R34356.1 R34357.1 R34358.1 R34359.1 R34360.1 R34361.1 R34362.1 R34363.1 R34364.1 R34365.1 R34366.1 R34367.1 R34368.1 R34369.1 R34370.1 R34371.1 R34372.1 R34373.1 R34374.1 R34375.1 R34376.1 R34377.1 R34378.1 R34379.1 R34380.1 R34381.1 R34382.1 R34383.1 R34384.1 R34385.1 R34386.1 R34387.1 R34388.1 R34389.1 R34390.1 R34391.1 R34392.1 R34393.1 R34394.1 R34395.1 R34396.1 R34397.1 R34398.1 R34399.1 R34400.1
N$181: R34201.2 R34202.2 R34203.2 R34204.2 R34205.2 R34206.2 R34207.2 R34208.2 R34209.2 R34210.2 R34211.2 R34212.2 R34213.2 R34214.2 R34215.2 R34216.2 R34217.2 R34218.2 R34219.2 R34220.2 R34221.2 R34222.2 R34223.2 R34224.2 R34225.2 R34226.2 R34227.2 R34228.2 R34229.2 R34230.2 R34231.2 R34232.2 R34233.2 R34234.2 R34235.2 R34236.2 R34237.2 R34238.2 R34239.2 R34240.2 R34241.2 R34242.2 R34243.2 R34244.2 R34245.2 R34246.2 R34247.2 R34248.2 R34249.2 R34250.2 R34251.2 R34252.2 R34253.2 R34254.2 R34255.2 R34256.2 R34257.2 R34258.2 R34259.2 R34260.2 R34261.2 R34262.2 R34263.2 R34264.2 R34265.2 R34266.2 R34267.2 R34268.2 R34269.2 R34270.2 R34271.2 R34272.2 R34273.2 R34274.2 R34275.2 R34276.2 R34277.2 R34278.2 R34279.2 R34280.2 R34281.2 R34282.2 R34283.2 R34284.2 R34285.2 R34286.2 R34287.2 R34288.2 R34289.2 R34290.2 R34291.2 R34292.2 R34293.2 R34294.2 R34295.2 R34296.2 R34297.2 R34298.2 R34299.2 R34300.2 R34301.2 R34302.2 R34303.2 R34304.2 R34305.2 R34306.2 R34307.2 R34308.2 R34309.2 R34310.2 R34311.2 R34312.2 R34313.2 R34314.2 R34315.2 R34316.2 R34317.2 R34318.2 R34319.2 R34320.2 R34321.2 R34322.2 R34323.2 R34324.2 R34325.2 R34326.2 R34327.2 R34328.2 R34329.2 R34330.2 R34331.2 R34332.2 R34333.2 R34334.2 R34335.2 R34336.2 R34337.2 R34338.2 R34339.2 R34340.2 R34341.2 R34342.2 R34343.2 R34344.2 R34345.2 R34346.2 R34347.2 R34348.2 R34349.2 R34350.2 R34351.2 R34352.2 R34353.2 R34354.2 R34355.2 R34356.2 R34357.2 R34358.2 R34359.2 R34360.2 R34361.2 R34362.2 R34363.2 R34364.2 R34365.2 R34366.2 R34367.2 R34368.2 R34369.2 R34370.2 R34371.2 R34372.2 R34373.2 R34374.2 R34375.2 R34376.2 R34377.2 R34378.2 R34379.2 R34380.2 R34381.2 R34382.2 R34383.2 R34384.2 R34385.2 R34386.2 R34387.2 R34388.2 R34389.2 R34390.2 R34391.2 R34392.2 R34393.2 R34394.2 R34395.2 R34396.2 R34397.2 R34398.2 R34399.2 R34400.2 R34401.1 R34402.1 R34403.1 R34404.1 R34405.1 R34406.1 R34407.1 R34408.1 R34409.1 R34410.1 R34411.1 R34412.1 R34413.1 R34414.1 R34415.1 R34416.1 R34417.1 R34418.1 R34419.1 R34420.1 R34421.1 R34422.1 R34423.1 R34424.1 R34425.1 R34426.1 R34427.1 R34428.1 R34429.1 R34430.1 R34431.1 R34432.1 R34433.1 R34434.1 R34435.1 R34436.1 R34437.1 R34438.1 R34439.1 R34440.1 R34441.1 R34442.1 R34443.1 R34444.1 R34445.1 R34446.1 R34447.1 R34448.1 R34449.1 R34450.1 R34451.1 R34452.1 R34453.1 R34454.1 R34455.1 R34456.1 R34457.1 R34458.1 R34459.1 R34460.1 R34461.1 R34462.1 R34463.1 R34464.1 R34465.1 R34466.1 R34467.1 R34468.1 R34469.1 R34470.1 R34471.1 R34472.1 R34473.1 R34474.1 R34475.1 R34476.1 R34477.1 R34478.1 R34479.1 R34480.1 R34481.1 R34482.1 R34483.1 R34484.1 R34485.1 R34486.1 R34487.1 R34488.1 R34489.1 R34490.1 R34491.1 R34492.1 R34493.1 R34494.1 R34495.1 R34496.1 R34497.1 R34498.1 R34499.1 R34500.1 R34501.1 R34502.1 R34503.1 R34504.1 R34505.1 R34506.1 R34507.1 R34508.1 R34509.1 R34510.1 R34511.1 R34512.1 R34513.1 R34514.1 R34515.1 R34516.1 R34517.1 R34518.1 R34519.1 R34520.1 R34521.1 R34522.1 R34523.1 R34524.1 R34525.1 R34526.1 R34527.1 R34528.1 R34529.1 R34530.1 R34531.1 R34532.1 R34533.1 R34534.1 R34535.1 R34536.1 R34537.1 R34538.1 R34539.1 R34540.1 R34541.1 R34542.1 R34543.1 R34544.1 R34545.1 R34546.1 R34547.1 R34548.1 R34549.1 R34550.1 R34551.1 R34552.1 R34553.1 R34554.1 R34555.1 R34556.1 R34557.1 R34558.1 R34559.1 R34560.1 R34561.1 R34562.1 R34563.1 R34564.1 R34565.1 R34566.1 R34567.1 R34568.1 R34569.1 R34570.1 R34571.1 R34572.1 R34573.1 R34574.1 R34575.1 R34576.1 R34577.1 R34578.1 R34579.1 R34580.1 R34581.1 R34582.1 R34583.1 R34584.1 R34585.1 R34586.1 R34587.1 R34588.1 R34589.1 R34590.1 R34591.1 R34592.1 R34593.1 R34594.1 R34595.1 R34596.1 R34597.1 R34598.1 R34599.1 R34600.1
N$182: R34401.2 R34402.2 R34403.2 R34404.2 R34405.2 R34406.2 R34407.2 R34408.2 R34409.2 R34410.2 R34411.2 R34412.2 R34413.2 R34414.2 R34415.2 R34416.2 R34417.2 R34418.2 R34419.2 R34420.2 R34421.2 R34422.2 R34423.2 R34424.2 R34425.2 R34426.2 R34427.2 R34428.2 R34429.2 R34430.2 R34431.2 R34432.2 R34433.2 R34434.2 R34435.2 R34436.2 R34437.2 R34438.2 R34439.2 R34440.2 R34441.2 R34442.2 R34443.2 R34444.2 R34445.2 R34446.2 R34447.2 R34448.2 R34449.2 R34450.2 R34451.2 R34452.2 R34453.2 R34454.2 R34455.2 R34456.2 R34457.2 R34458.2 R34459.2 R34460.2 R34461.2 R34462.2 R34463.2 R34464.2 R34465.2 R34466.2 R34467.2 R34468.2 R34469.2 R34470.2 R34471.2 R34472.2 R34473.2 R34474.2 R34475.2 R34476.2 R34477.2 R34478.2 R34479.2 R34480.2 R34481.2 R34482.2 R34483.2 R34484.2 R34485.2 R34486.2 R34487.2 R34488.2 R34489.2 R34490.2 R34491.2 R34492.2 R34493.2 R34494.2 R34495.2 R34496.2 R34497.2 R34498.2 R34499.2 R34500.2 R34501.2 R34502.2 R34503.2 R34504.2 R34505.2 R34506.2 R34507.2 R34508.2 R34509.2 R34510.2 R34511.2 R34512.2 R34513.2 R34514.2 R34515.2 R34516.2 R34517.2 R34518.2 R34519.2 R34520.2 R34521.2 R34522.2 R34523.2 R34524.2 R34525.2 R34526.2 R34527.2 R34528.2 R34529.2 R34530.2 R34531.2 R34532.2 R34533.2 R34534.2 R34535.2 R34536.2 R34537.2 R34538.2 R34539.2 R34540.2 R34541.2 R34542.2 R34543.2 R34544.2 R34545.2 R34546.2 R34547.2 R34548.2 R34549.2 R34550.2 R34551.2 R34552.2 R34553.2 R34554.2 R34555.2 R34556.2 R34557.2 R34558.2 R34559.2 R34560.2 R34561.2 R34562.2 R34563.2 R34564.2 R34565.2 R34566.2 R34567.2 R34568.2 R34569.2 R34570.2 R34571.2 R34572.2 R34573.2 R34574.2 R34575.2 R34576.2 R34577.2 R34578.2 R34579.2 R34580.2 R34581.2 R34582.2 R34583.2 R34584.2 R34585.2 R34586.2 R34587.2 R34588.2 R34589.2 R34590.2 R34591.2 R34592.2 R34593.2 R34594.2 R34595.2 R34596.2 R34597.2 R34598.2 R34599.2 R34600.2 R34601.1 R34602.1 R34603.1 R34604.1 R34605.1 R34606.1 R34607.1 R34608.1 R34609.1 R34610.1 R34611.1 R34612.1 R34613.1 R34614.1 R34615.1 R34616.1 R34617.1 R34618.1 R34619.1 R34620.1 R34621.1 R34622.1 R34623.1 R34624.1 R34625.1 R34626.1 R34627.1 R34628.1 R34629.1 R34630.1 R34631.1 R34632.1 R34633.1 R34634.1 R34635.1 R34636.1 R34637.1 R34638.1 R34639.1 R34640.1 R34641.1 R34642.1 R34643.1 R34644.1 R34645.1 R34646.1 R34647.1 R34648.1 R34649.1 R34650.1 R34651.1 R34652.1 R34653.1 R34654.1 R34655.1 R34656.1 R34657.1 R34658.1 R34659.1 R34660.1 R34661.1 R34662.1 R34663.1 R34664.1 R34665.1 R34666.1 R34667.1 R34668.1 R34669.1 R34670.1 R34671.1 R34672.1 R34673.1 R34674.1 R34675.1 R34676.1 R34677.1 R34678.1 R34679.1 R34680.1 R34681.1 R34682.1 R34683.1 R34684.1 R34685.1 R34686.1 R34687.1 R34688.1 R34689.1 R34690.1 R34691.1 R34692.1 R34693.1 R34694.1 R34695.1 R34696.1 R34697.1 R34698.1 R34699.1 R34700.1 R34701.1 R34702.1 R34703.1 R34704.1 R34705.1 R34706.1 R34707.1 R34708.1 R34709.1 R34710.1 R34711.1 R34712.1 R34713.1 R34714.1 R34715.1 R34716.1 R34717.1 R34718.1 R34719.1 R34720.1 R34721.1 R34722.1 R34723.1 R34724.1 R34725.1 R34726.1 R34727.1 R34728.1 R34729.1 R34730.1 R34731.1 R34732.1 R34733.1 R34734.1 R34735.1 R34736.1 R34737.1 R34738.1 R34739.1 R34740.1 R34741.1 R34742.1 R34743.1 R34744.1 R34745.1 R34746.1 R34747.1 R34748.1 R34749.1 R34750.1 R34751.1 R34752.1 R34753.1 R34754.1 R34755.1 R34756.1 R34757.1 R34758.1 R34759.1 R34760.1 R34761.1 R34762.1 R34763.1 R34764.1 R34765.1 R34766.1 R34767.1 R34768.1 R34769.1 R34770.1 R34771.1 R34772.1 R34773.1 R34774.1 R34775.1 R34776.1 R34777.1 R34778.1 R34779.1 R34780.1 R34781.1 R34782.1 R34783.1 R34784.1 R34785.1 R34786.1 R34787.1 R34788.1 R34789.1 R34790.1 R34791.1 R34792.1 R34793.1 R34794.1 R34795.1 R34796.1 R34797.1 R34798.1 R34799.1 R34800.1
N$183: R34601.2 R34602.2 R34603.2 R34604.2 R34605.2 R34606.2 R34607.2 R34608.2 R34609.2 R34610.2 R34611.2 R34612.2 R34613.2 R34614.2 R34615.2 R34616.2 R34617.2 R34618.2 R34619.2 R34620.2 R34621.2 R34622.2 R34623.2 R34624.2 R34625.2 R34626.2 R34627.2 R34628.2 R34629.2 R34630.2 R34631.2 R34632.2 R34633.2 R34634.2 R34635.2 R34636.2 R34637.2 R34638.2 R34639.2 R34640.2 R34641.2 R34642.2 R34643.2 R34644.2 R34645.2 R34646.2 R34647.2 R34648.2 R34649.2 R34650.2 R34651.2 R34652.2 R34653.2 R34654.2 R34655.2 R34656.2 R34657.2 R34658.2 R34659.2 R34660.2 R34661.2 R34662.2 R34663.2 R34664.2 R34665.2 R34666.2 R34667.2 R34668.2 R34669.2 R34670.2 R34671.2 R34672.2 R34673.2 R34674.2 R34675.2 R34676.2 R34677.2 R34678.2 R34679.2 R34680.2 R34681.2 R34682.2 R34683.2 R34684.2 R34685.2 R34686.2 R34687.2 R34688.2 R34689.2 R34690.2 R34691.2 R34692.2 R34693.2 R34694.2 R34695.2 R34696.2 R34697.2 R34698.2 R34699.2 R34700.2 R34701.2 R34702.2 R34703.2 R34704.2 R34705.2 R34706.2 R34707.2 R34708.2 R34709.2 R34710.2 R34711.2 R34712.2 R34713.2 R34714.2 R34715.2 R34716.2 R34717.2 R34718.2 R34719.2 R34720.2 R34721.2 R34722.2 R34723.2 R34724.2 R34725.2 R34726.2 R34727.2 R34728.2 R34729.2 R34730.2 R34731.2 R34732.2 R34733.2 R34734.2 R34735.2 R34736.2 R34737.2 R34738.2 R34739.2 R34740.2 R34741.2 R34742.2 R34743.2 R34744.2 R34745.2 R34746.2 R34747.2 R34748.2 R34749.2 R34750.2 R34751.2 R34752.2 R34753.2 R34754.2 R34755.2 R34756.2 R34757.2 R34758.2 R34759.2 R34760.2 R34761.2 R34762.2 R34763.2 R34764.2 R34765.2 R34766.2 R34767.2 R34768.2 R34769.2 R34770.2 R34771.2 R34772.2 R34773.2 R34774.2 R34775.2 R34776.2 R34777.2 R34778.2 R34779.2 R34780.2 R34781.2 R34782.2 R34783.2 R34784.2 R34785.2 R34786.2 R34787.2 R34788.2 R34789.2 R34790.2 R34791.2 R34792.2 R34793.2 R34794.2 R34795.2 R34796.2 R34797.2 R34798.2 R34799.2 R34800.2 R34801.1 R34802.1 R34803.1 R34804.1 R34805.1 R34806.1 R34807.1 R34808.1 R34809.1 R34810.1 R34811.1 R34812.1 R34813.1 R34814.1 R34815.1 R34816.1 R34817.1 R34818.1 R34819.1 R34820.1 R34821.1 R34822.1 R34823.1 R34824.1 R34825.1 R34826.1 R34827.1 R34828.1 R34829.1 R34830.1 R34831.1 R34832.1 R34833.1 R34834.1 R34835.1 R34836.1 R34837.1 R34838.1 R34839.1 R34840.1 R34841.1 R34842.1 R34843.1 R34844.1 R34845.1 R34846.1 R34847.1 R34848.1 R34849.1 R34850.1 R34851.1 R34852.1 R34853.1 R34854.1 R34855.1 R34856.1 R34857.1 R34858.1 R34859.1 R34860.1 R34861.1 R34862.1 R34863.1 R34864.1 R34865.1 R34866.1 R34867.1 R34868.1 R34869.1 R34870.1 R34871.1 R34872.1 R34873.1 R34874.1 R34875.1 R34876.1 R34877.1 R34878.1 R34879.1 R34880.1 R34881.1 R34882.1 R34883.1 R34884.1 R34885.1 R34886.1 R34887.1 R34888.1 R34889.1 R34890.1 R34891.1 R34892.1 R34893.1 R34894.1 R34895.1 R34896.1 R34897.1 R34898.1 R34899.1 R34900.1 R34901.1 R34902.1 R34903.1 R34904.1 R34905.1 R34906.1 R34907.1 R34908.1 R34909.1 R34910.1 R34911.1 R34912.1 R34913.1 R34914.1 R34915.1 R34916.1 R34917.1 R34918.1 R34919.1 R34920.1 R34921.1 R34922.1 R34923.1 R34924.1 R34925.1 R34926.1 R34927.1 R34928.1 R34929.1 R34930.1 R34931.1 R34932.1 R34933.1 R34934.1 R34935.1 R34936.1 R34937.1 R34938.1 R34939.1 R34940.1 R34941.1 R34942.1 R34943.1 R34944.1 R34945.1 R34946.1 R34947.1 R34948.1 R34949.1 R34950.1 R34951.1 R34952.1 R34953.1 R34954.1 R34955.1 R34956.1 R34957.1 R34958.1 R34959.1 R34960.1 R34961.1 R34962.1 R34963.1 R34964.1 R34965.1 R34966.1 R34967.1 R34968.1 R34969.1 R34970.1 R34971.1 R34972.1 R34973.1 R34974.1 R34975.1 R34976.1 R34977.1 R34978.1 R34979.1 R34980.1 R34981.1 R34982.1 R34983.1 R34984.1 R34985.1 R34986.1 R34987.1 R34988.1 R34989.1 R34990.1 R34991.1 R34992.1 R34993.1 R34994.1 R34995.1 R34996.1 R34997.1 R34998.1 R34999.1 R35000.1
N$184: R34801.2 R34802.2 R34803.2 R34804.2 R34805.2 R34806.2 R34807.2 R34808.2 R34809.2 R34810.2 R34811.2 R34812.2 R34813.2 R34814.2 R34815.2 R34816.2 R34817.2 R34818.2 R34819.2 R34820.2 R34821.2 R34822.2 R34823.2 R34824.2 R34825.2 R34826.2 R34827.2 R34828.2 R34829.2 R34830.2 R34831.2 R34832.2 R34833.2 R34834.2 R34835.2 R34836.2 R34837.2 R34838.2 R34839.2 R34840.2 R34841.2 R34842.2 R34843.2 R34844.2 R34845.2 R34846.2 R34847.2 R34848.2 R34849.2 R34850.2 R34851.2 R34852.2 R34853.2 R34854.2 R34855.2 R34856.2 R34857.2 R34858.2 R34859.2 R34860.2 R34861.2 R34862.2 R34863.2 R34864.2 R34865.2 R34866.2 R34867.2 R34868.2 R34869.2 R34870.2 R34871.2 R34872.2 R34873.2 R34874.2 R34875.2 R34876.2 R34877.2 R34878.2 R34879.2 R34880.2 R34881.2 R34882.2 R34883.2 R34884.2 R34885.2 R34886.2 R34887.2 R34888.2 R34889.2 R34890.2 R34891.2 R34892.2 R34893.2 R34894.2 R34895.2 R34896.2 R34897.2 R34898.2 R34899.2 R34900.2 R34901.2 R34902.2 R34903.2 R34904.2 R34905.2 R34906.2 R34907.2 R34908.2 R34909.2 R34910.2 R34911.2 R34912.2 R34913.2 R34914.2 R34915.2 R34916.2 R34917.2 R34918.2 R34919.2 R34920.2 R34921.2 R34922.2 R34923.2 R34924.2 R34925.2 R34926.2 R34927.2 R34928.2 R34929.2 R34930.2 R34931.2 R34932.2 R34933.2 R34934.2 R34935.2 R34936.2 R34937.2 R34938.2 R34939.2 R34940.2 R34941.2 R34942.2 R34943.2 R34944.2 R34945.2 R34946.2 R34947.2 R34948.2 R34949.2 R34950.2 R34951.2 R34952.2 R34953.2 R34954.2 R34955.2 R34956.2 R34957.2 R34958.2 R34959.2 R34960.2 R34961.2 R34962.2 R34963.2 R34964.2 R34965.2 R34966.2 R34967.2 R34968.2 R34969.2 R34970.2 R34971.2 R34972.2 R34973.2 R34974.2 R34975.2 R34976.2 R34977.2 R34978.2 R34979.2 R34980.2 R34981.2 R34982.2 R34983.2 R34984.2 R34985.2 R34986.2 R34987.2 R34988.2 R34989.2 R34990.2 R34991.2 R34992.2 R34993.2 R34994.2 R34995.2 R34996.2 R34997.2 R34998.2 R34999.2 R35000.2 R35001.1 R35002.1 R35003.1 R35004.1 R35005.1 R35006.1 R35007.1 R35008.1 R35009.1 R35010.1 R35011.1 R35012.1 R35013.1 R35014.1 R35015.1 R35016.1 R35017.1 R35018.1 R35019.1 R35020.1 R35021.1 R35022.1 R35023.1 R35024.1 R35025.1 R35026.1 R35027.1 R35028.1 R35029.1 R35030.1 R35031.1 R35032.1 R35033.1 R35034.1 R35035.1 R35036.1 R35037.1 R35038.1 R35039.1 R35040.1 R35041.1 R35042.1 R35043.1 R35044.1 R35045.1 R35046.1 R35047.1 R35048.1 R35049.1 R35050.1 R35051.1 R35052.1 R35053.1 R35054.1 R35055.1 R35056.1 R35057.1 R35058.1 R35059.1 R35060.1 R35061.1 R35062.1 R35063.1 R35064.1 R35065.1 R35066.1 R35067.1 R35068.1 R35069.1 R35070.1 R35071.1 R35072.1 R35073.1 R35074.1 R35075.1 R35076.1 R35077.1 R35078.1 R35079.1 R35080.1 R35081.1 R35082.1 R35083.1 R35084.1 R35085.1 R35086.1 R35087.1 R35088.1 R35089.1 R35090.1 R35091.1 R35092.1 R35093.1 R35094.1 R35095.1 R35096.1 R35097.1 R35098.1 R35099.1 R35100.1 R35101.1 R35102.1 R35103.1 R35104.1 R35105.1 R35106.1 R35107.1 R35108.1 R35109.1 R35110.1 R35111.1 R35112.1 R35113.1 R35114.1 R35115.1 R35116.1 R35117.1 R35118.1 R35119.1 R35120.1 R35121.1 R35122.1 R35123.1 R35124.1 R35125.1 R35126.1 R35127.1 R35128.1 R35129.1 R35130.1 R35131.1 R35132.1 R35133.1 R35134.1 R35135.1 R35136.1 R35137.1 R35138.1 R35139.1 R35140.1 R35141.1 R35142.1 R35143.1 R35144.1 R35145.1 R35146.1 R35147.1 R35148.1 R35149.1 R35150.1 R35151.1 R35152.1 R35153.1 R35154.1 R35155.1 R35156.1 R35157.1 R35158.1 R35159.1 R35160.1 R35161.1 R35162.1 R35163.1 R35164.1 R35165.1 R35166.1 R35167.1 R35168.1 R35169.1 R35170.1 R35171.1 R35172.1 R35173.1 R35174.1 R35175.1 R35176.1 R35177.1 R35178.1 R35179.1 R35180.1 R35181.1 R35182.1 R35183.1 R35184.1 R35185.1 R35186.1 R35187.1 R35188.1 R35189.1 R35190.1 R35191.1 R35192.1 R35193.1 R35194.1 R35195.1 R35196.1 R35197.1 R35198.1 R35199.1 R35200.1
N$185: R35001.2 R35002.2 R35003.2 R35004.2 R35005.2 R35006.2 R35007.2 R35008.2 R35009.2 R35010.2 R35011.2 R35012.2 R35013.2 R35014.2 R35015.2 R35016.2 R35017.2 R35018.2 R35019.2 R35020.2 R35021.2 R35022.2 R35023.2 R35024.2 R35025.2 R35026.2 R35027.2 R35028.2 R35029.2 R35030.2 R35031.2 R35032.2 R35033.2 R35034.2 R35035.2 R35036.2 R35037.2 R35038.2 R35039.2 R35040.2 R35041.2 R35042.2 R35043.2 R35044.2 R35045.2 R35046.2 R35047.2 R35048.2 R35049.2 R35050.2 R35051.2 R35052.2 R35053.2 R35054.2 R35055.2 R35056.2 R35057.2 R35058.2 R35059.2 R35060.2 R35061.2 R35062.2 R35063.2 R35064.2 R35065.2 R35066.2 R35067.2 R35068.2 R35069.2 R35070.2 R35071.2 R35072.2 R35073.2 R35074.2 R35075.2 R35076.2 R35077.2 R35078.2 R35079.2 R35080.2 R35081.2 R35082.2 R35083.2 R35084.2 R35085.2 R35086.2 R35087.2 R35088.2 R35089.2 R35090.2 R35091.2 R35092.2 R35093.2 R35094.2 R35095.2 R35096.2 R35097.2 R35098.2 R35099.2 R35100.2 R35101.2 R35102.2 R35103.2 R35104.2 R35105.2 R35106.2 R35107.2 R35108.2 R35109.2 R35110.2 R35111.2 R35112.2 R35113.2 R35114.2 R35115.2 R35116.2 R35117.2 R35118.2 R35119.2 R35120.2 R35121.2 R35122.2 R35123.2 R35124.2 R35125.2 R35126.2 R35127.2 R35128.2 R35129.2 R35130.2 R35131.2 R35132.2 R35133.2 R35134.2 R35135.2 R35136.2 R35137.2 R35138.2 R35139.2 R35140.2 R35141.2 R35142.2 R35143.2 R35144.2 R35145.2 R35146.2 R35147.2 R35148.2 R35149.2 R35150.2 R35151.2 R35152.2 R35153.2 R35154.2 R35155.2 R35156.2 R35157.2 R35158.2 R35159.2 R35160.2 R35161.2 R35162.2 R35163.2 R35164.2 R35165.2 R35166.2 R35167.2 R35168.2 R35169.2 R35170.2 R35171.2 R35172.2 R35173.2 R35174.2 R35175.2 R35176.2 R35177.2 R35178.2 R35179.2 R35180.2 R35181.2 R35182.2 R35183.2 R35184.2 R35185.2 R35186.2 R35187.2 R35188.2 R35189.2 R35190.2 R35191.2 R35192.2 R35193.2 R35194.2 R35195.2 R35196.2 R35197.2 R35198.2 R35199.2 R35200.2 R35201.1 R35202.1 R35203.1 R35204.1 R35205.1 R35206.1 R35207.1 R35208.1 R35209.1 R35210.1 R35211.1 R35212.1 R35213.1 R35214.1 R35215.1 R35216.1 R35217.1 R35218.1 R35219.1 R35220.1 R35221.1 R35222.1 R35223.1 R35224.1 R35225.1 R35226.1 R35227.1 R35228.1 R35229.1 R35230.1 R35231.1 R35232.1 R35233.1 R35234.1 R35235.1 R35236.1 R35237.1 R35238.1 R35239.1 R35240.1 R35241.1 R35242.1 R35243.1 R35244.1 R35245.1 R35246.1 R35247.1 R35248.1 R35249.1 R35250.1 R35251.1 R35252.1 R35253.1 R35254.1 R35255.1 R35256.1 R35257.1 R35258.1 R35259.1 R35260.1 R35261.1 R35262.1 R35263.1 R35264.1 R35265.1 R35266.1 R35267.1 R35268.1 R35269.1 R35270.1 R35271.1 R35272.1 R35273.1 R35274.1 R35275.1 R35276.1 R35277.1 R35278.1 R35279.1 R35280.1 R35281.1 R35282.1 R35283.1 R35284.1 R35285.1 R35286.1 R35287.1 R35288.1 R35289.1 R35290.1 R35291.1 R35292.1 R35293.1 R35294.1 R35295.1 R35296.1 R35297.1 R35298.1 R35299.1 R35300.1 R35301.1 R35302.1 R35303.1 R35304.1 R35305.1 R35306.1 R35307.1 R35308.1 R35309.1 R35310.1 R35311.1 R35312.1 R35313.1 R35314.1 R35315.1 R35316.1 R35317.1 R35318.1 R35319.1 R35320.1 R35321.1 R35322.1 R35323.1 R35324.1 R35325.1 R35326.1 R35327.1 R35328.1 R35329.1 R35330.1 R35331.1 R35332.1 R35333.1 R35334.1 R35335.1 R35336.1 R35337.1 R35338.1 R35339.1 R35340.1 R35341.1 R35342.1 R35343.1 R35344.1 R35345.1 R35346.1 R35347.1 R35348.1 R35349.1 R35350.1 R35351.1 R35352.1 R35353.1 R35354.1 R35355.1 R35356.1 R35357.1 R35358.1 R35359.1 R35360.1 R35361.1 R35362.1 R35363.1 R35364.1 R35365.1 R35366.1 R35367.1 R35368.1 R35369.1 R35370.1 R35371.1 R35372.1 R35373.1 R35374.1 R35375.1 R35376.1 R35377.1 R35378.1 R35379.1 R35380.1 R35381.1 R35382.1 R35383.1 R35384.1 R35385.1 R35386.1 R35387.1 R35388.1 R35389.1 R35390.1 R35391.1 R35392.1 R35393.1 R35394.1 R35395.1 R35396.1 R35397.1 R35398.1 R35399.1 R35400.1